# Altium schematic sheet SysUprTestUUDown.SchDoc
size 839 x 594 mm; DecimalNumber: Э- 917.02Э3; MainDevice: Плата источника питания; Name: Плата источника питания; PageSetup: Record=PageOptions|CenterHorizontal=True|CenterVertical=True|PrintScale=0.94|XCorrection=1.00|YCorrection=1.00|PrintKind=1|BorderSize=5000000|LeftOffset=0|BottomOffset=0|Orientation=1|PaperLength=1000|PaperWidth=1000|Scale=100|PaperSource=7|PrintQuality=-4|MediaType=1|DitherType=10|PaperKind=A4|PrintScaleMode=1; ApprovedBy: Кайбалдиев; CheckedBy: Савельев; DrawnBy: Соловьев; Engineer: Т.контр.; DocumentNumber: Э-917.02Э3; SheetNumber: 2; SheetTotal: 4; Title1str: Плата; Title2str: источника питания; DocumentType1str: Схема электрическая; DocumentType2str: принципиальная; ImagePath: Э-917.02
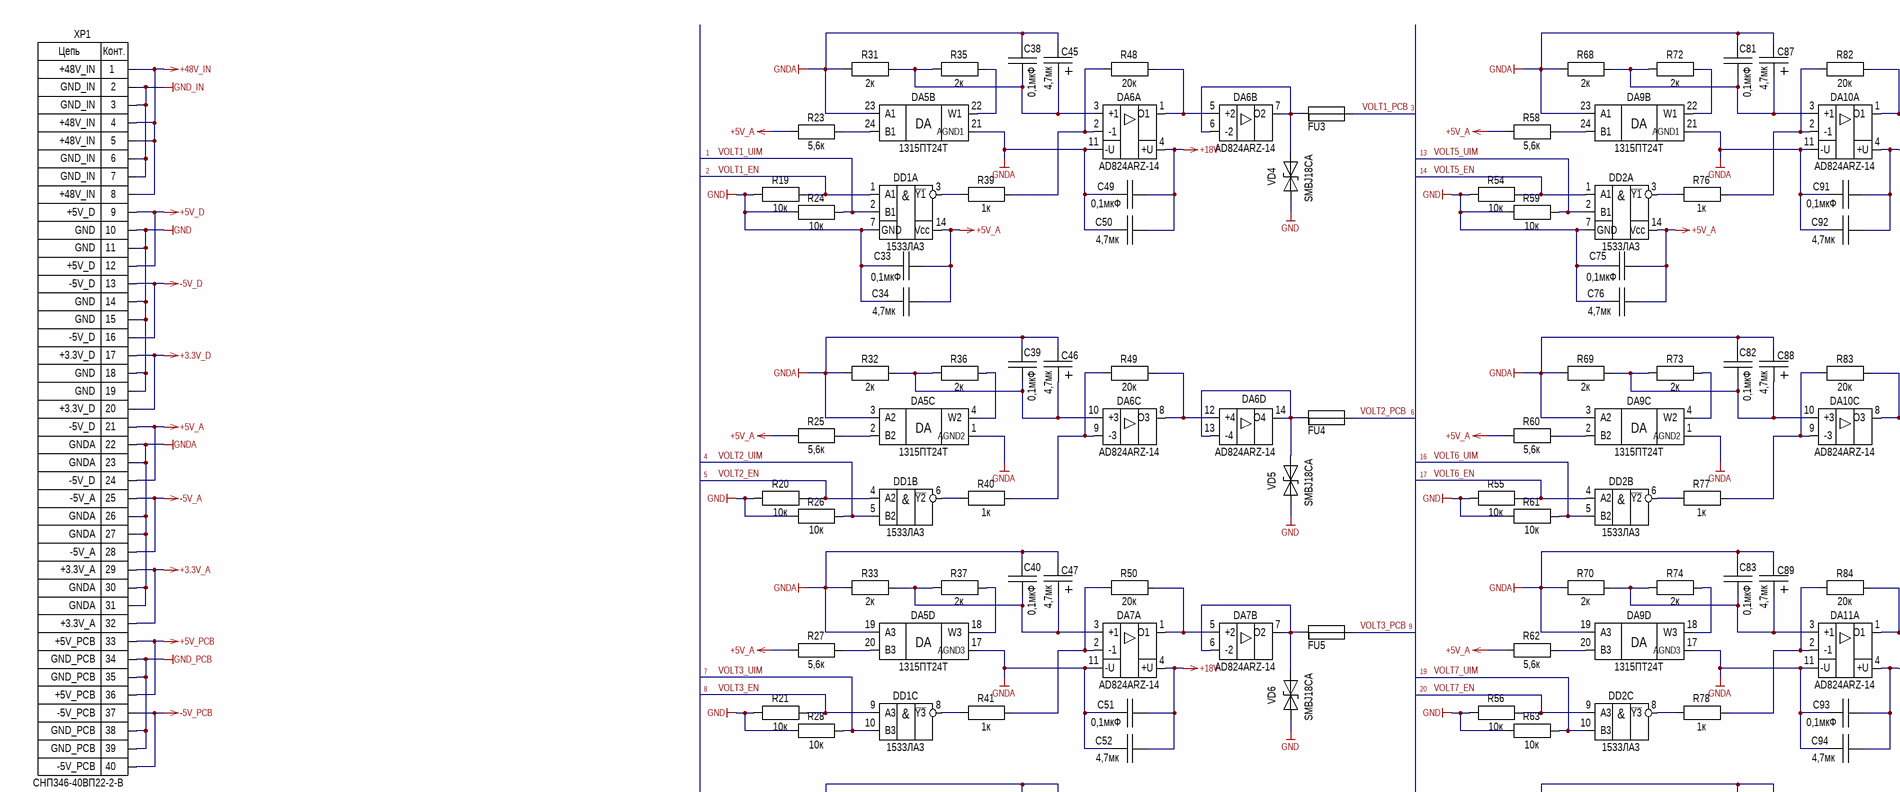
[diagram p0: SysUprTestUUDown.SchDoc, top left]
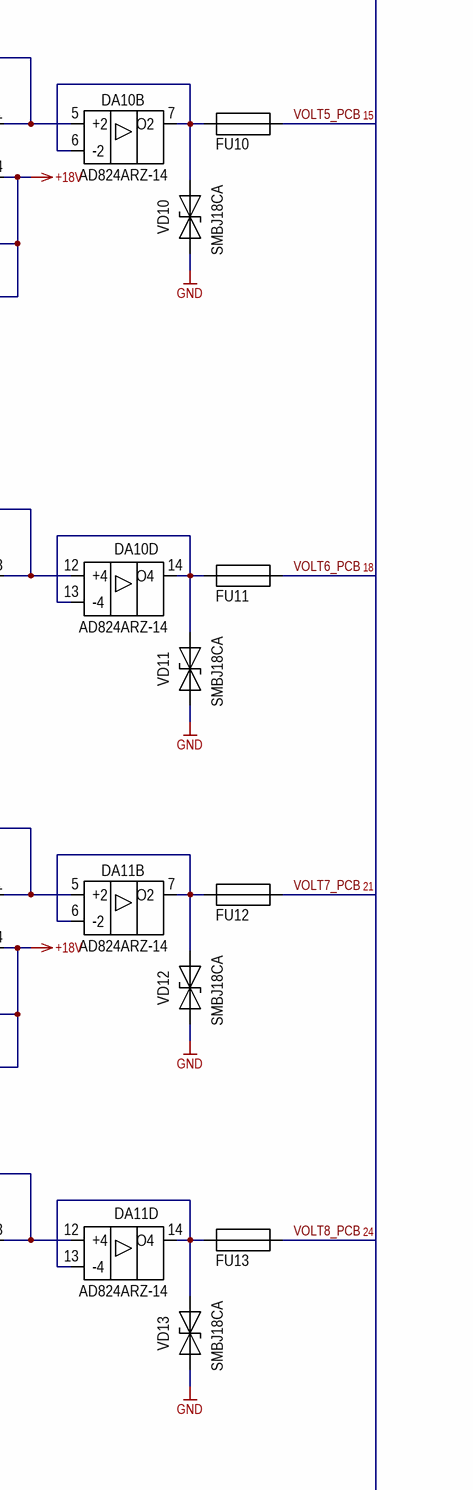
[diagram p1: SysUprTestUUDown.SchDoc, top right]
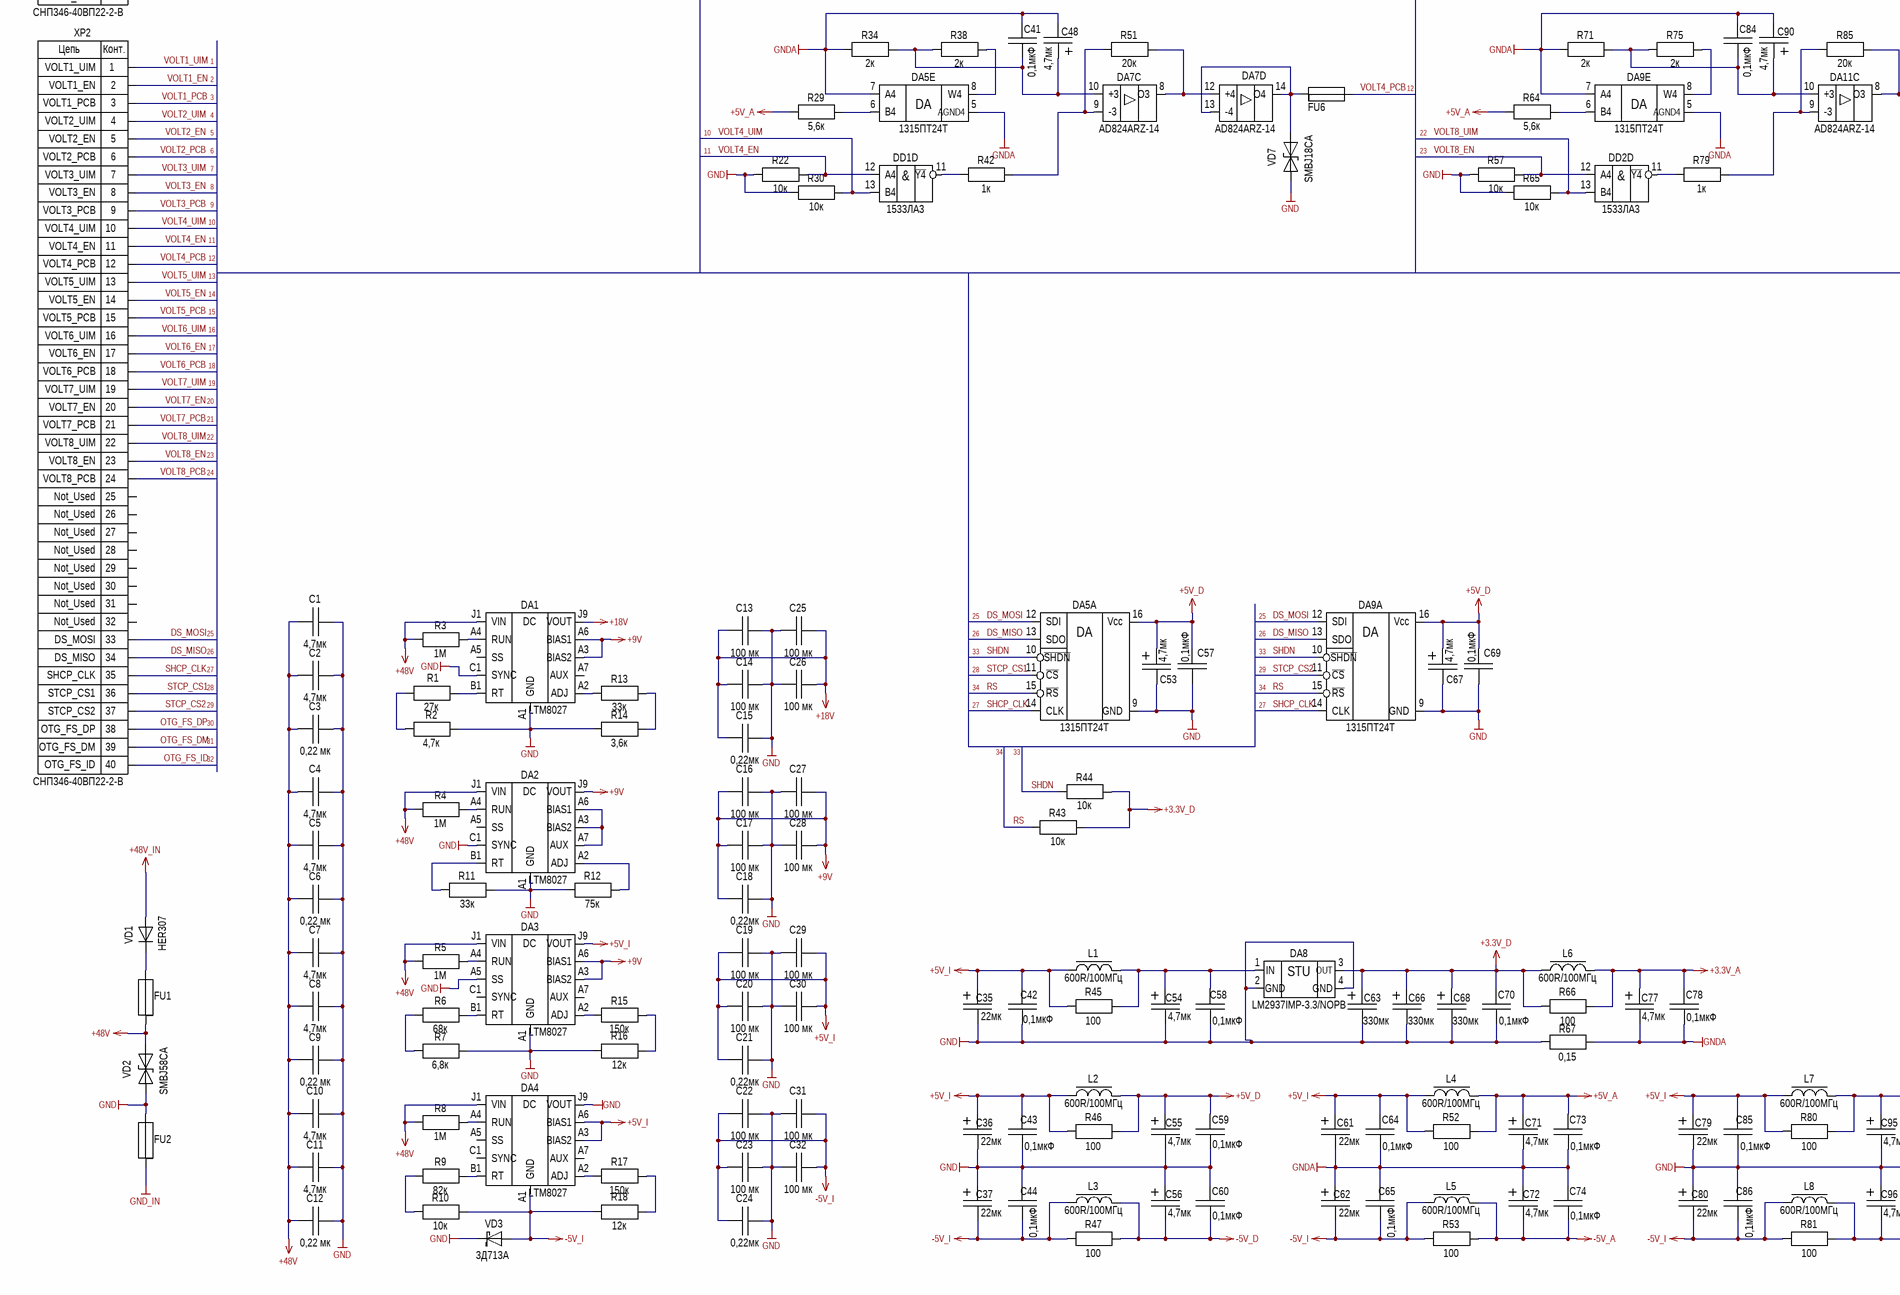
[diagram p2: SysUprTestUUDown.SchDoc, bottom left]
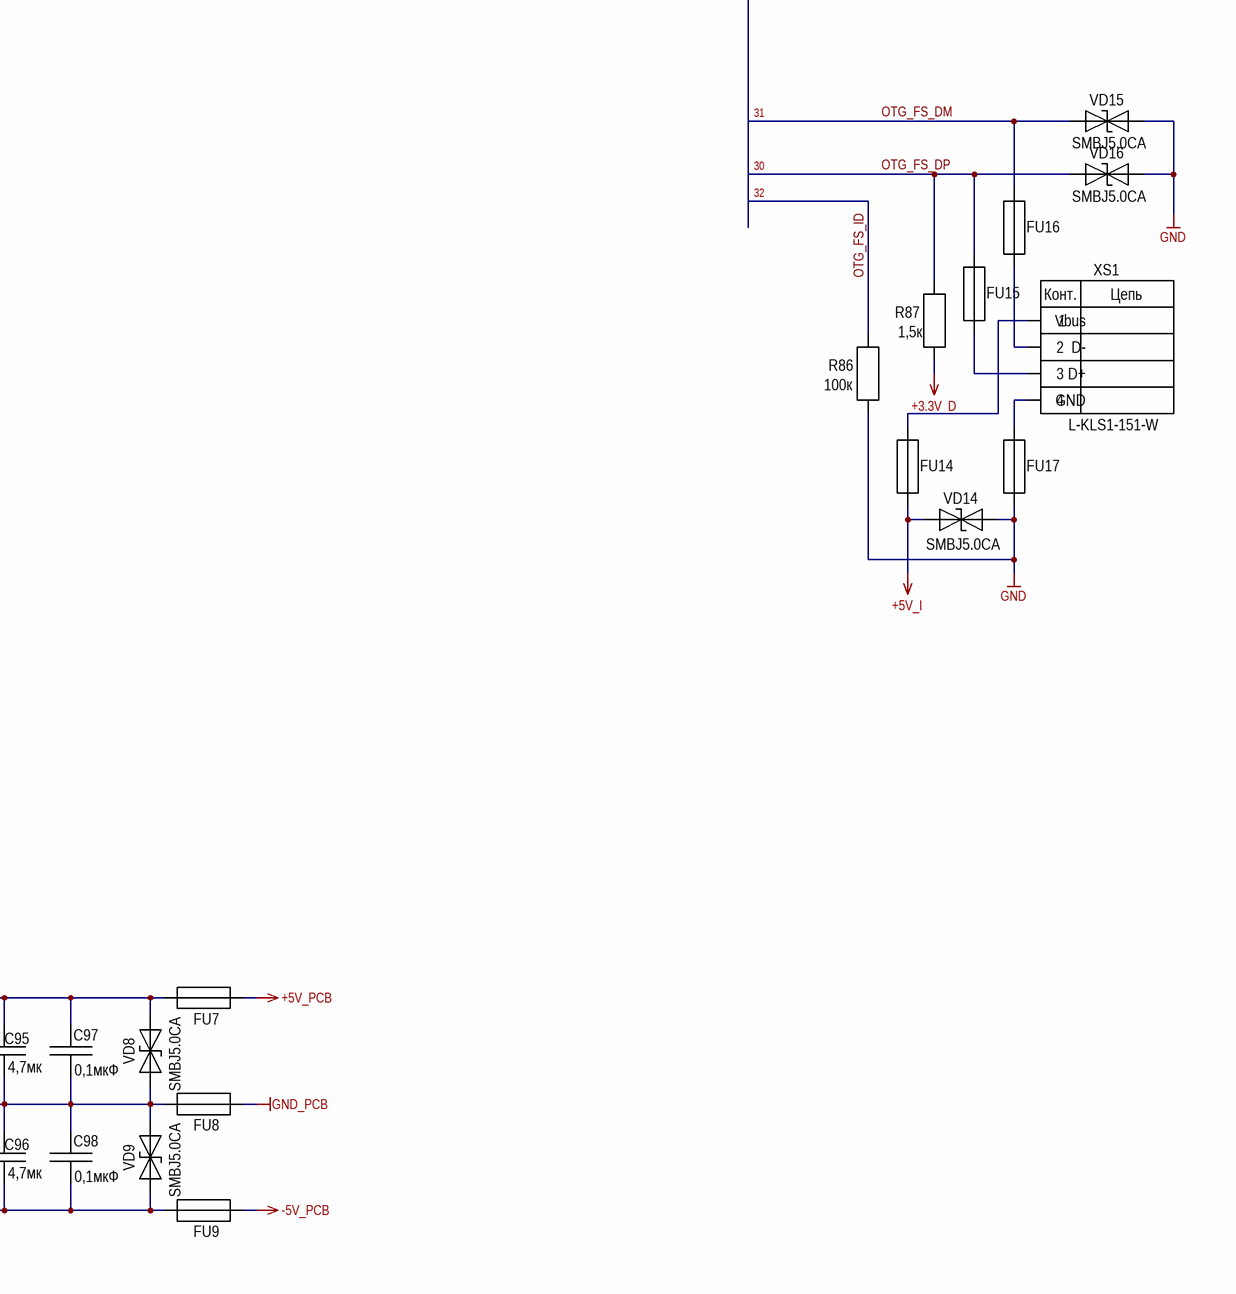
[diagram p3: SysUprTestUUDown.SchDoc, bottom right]

## Parts
C1  value 4,7мк  [CAP8060M H=5,6 мм]  (hidden comment: Capacitor)
C2  value 4,7мк  [CAP8060M H=5,6 мм]  (hidden comment: Capacitor)
C3  value 0,22 мк  [Cap1206]  (hidden comment: Capacitor)
C4  value 4,7мк  [CAP8060M H=5,6 мм]  (hidden comment: Capacitor)
C5  value 4,7мк  [CAP8060M H=5,6 мм]  (hidden comment: Capacitor)
C6  value 0,22 мк  [Cap1206]  (hidden comment: Capacitor)
C7  value 4,7мк  [CAP8060M H=5,6 мм]  (hidden comment: Capacitor)
C8  value 4,7мк  [CAP8060M H=5,6 мм]  (hidden comment: Capacitor)
C9  value 0,22 мк  [Cap1206]  (hidden comment: Capacitor)
C10  value 4,7мк  [CAP8060M H=5,6 мм]  (hidden comment: Capacitor)
C11  value 4,7мк  [CAP8060M H=5,6 мм]  (hidden comment: Capacitor)
C12  value 0,22 мк  [Cap1206]  (hidden comment: Capacitor)
C13  value 100 мк  [CAP2220 H=5.5мм]  (hidden comment: Capacitor)
C14  value 100 мк  [CAP2220 H=5.5мм]  (hidden comment: Capacitor)
C15  value 0,22мк  [Cap0805]  (hidden comment: Capacitor)
C16  value 100 мк  [CAP2220 H=5.5мм]  (hidden comment: Capacitor)
C17  value 100 мк  [CAP2220 H=5.5мм]  (hidden comment: Capacitor)
C18  value 0,22мк  [Cap0805]  (hidden comment: Capacitor)
C19  value 100 мк  [CAP2220 H=5.5мм]  (hidden comment: Capacitor)
C20  value 100 мк  [CAP2220 H=5.5мм]  (hidden comment: Capacitor)
C21  value 0,22мк  [Cap0805]  (hidden comment: Capacitor)
C22  value 100 мк  [CAP2220 H=5.5мм]  (hidden comment: Capacitor)
C23  value 100 мк  [CAP2220 H=5.5мм]  (hidden comment: Capacitor)
C24  value 0,22мк  [Cap0805]  (hidden comment: Capacitor)
C25  value 100 мк  [CAP2220 H=5.5мм]  (hidden comment: Capacitor)
C26  value 100 мк  [CAP2220 H=5.5мм]  (hidden comment: Capacitor)
C27  value 100 мк  [CAP2220 H=5.5мм]  (hidden comment: Capacitor)
C28  value 100 мк  [CAP2220 H=5.5мм]  (hidden comment: Capacitor)
C29  value 100 мк  [CAP2220 H=5.5мм]  (hidden comment: Capacitor)
C30  value 100 мк  [CAP2220 H=5.5мм]  (hidden comment: Capacitor)
C31  value 100 мк  [CAP2220 H=5.5мм]  (hidden comment: Capacitor)
C32  value 100 мк  [CAP2220 H=5.5мм]  (hidden comment: Capacitor)
C33  value 0,1мкФ  [Cap0805]  (hidden comment: Capacitor)
C34  value 4,7мк  [CAP1812]  (hidden comment: Capacitor)
C35  value 22мк  [CapCaseC]  (hidden comment: PolCap)
C36  value 22мк  [CapCaseC]  (hidden comment: PolCap)
C37  value 22мк  [CapCaseC]  (hidden comment: PolCap)
C38  value 0,1мкФ  [Cap0805]  (hidden comment: Capacitor)
C39  value 0,1мкФ  [Cap0805]  (hidden comment: Capacitor)
C40  value 0,1мкФ  [Cap0805]  (hidden comment: Capacitor)
C41  value 0,1мкФ  [Cap0805]  (hidden comment: Capacitor)
C42  value 0,1мкФ  [Cap0805]  (hidden comment: Capacitor)
C43  value 0,1мкФ  [Cap0805]  (hidden comment: Capacitor)
C44  value 0,1мкФ  [Cap0805]  (hidden comment: Capacitor)
C45  value 4,7мк  [CapCaseB]  (hidden comment: PolCap)
C46  value 4,7мк  [CapCaseB]  (hidden comment: PolCap)
C47  value 4,7мк  [CapCaseB]  (hidden comment: PolCap)
C48  value 4,7мк  [CapCaseB]  (hidden comment: PolCap)
C49  value 0,1мкФ  [Cap0805]  (hidden comment: Capacitor)
C50  value 4,7мк  [CAP1812]  (hidden comment: Capacitor)
C51  value 0,1мкФ  [Cap0805]  (hidden comment: Capacitor)
C52  value 4,7мк  [CAP1812]  (hidden comment: Capacitor)
C53  value 4,7мк  [CapCaseB]  (hidden comment: PolCap)
C54  value 4,7мк  [CapCaseB]  (hidden comment: PolCap)
C55  value 4,7мк  [CapCaseB]  (hidden comment: PolCap)
C56  value 4,7мк  [CapCaseB]  (hidden comment: PolCap)
C57  value 0,1мкФ  [Cap0805]  (hidden comment: Capacitor)
C58  value 0,1мкФ  [Cap0805]  (hidden comment: Capacitor)
C59  value 0,1мкФ  [Cap0805]  (hidden comment: Capacitor)
C60  value 0,1мкФ  [Cap0805]  (hidden comment: Capacitor)
C61  value 22мк  [CapCaseC]  (hidden comment: PolCap)
C62  value 22мк  [CapCaseC]  (hidden comment: PolCap)
C63  value 330мк  [CapCaseD]  (hidden comment: PolCap)
C64  value 0,1мкФ  [Cap0805]  (hidden comment: Capacitor)
C65  value 0,1мкФ  [Cap0805]  (hidden comment: Capacitor)
C66  value 330мк  [CapCaseD]  (hidden comment: PolCap)
C67  value 4,7мк  [CapCaseB]  (hidden comment: PolCap)
C68  value 330мк  [CapCaseD]  (hidden comment: PolCap)
C69  value 0,1мкФ  [Cap0805]  (hidden comment: Capacitor)
C70  value 0,1мкФ  [Cap0805]  (hidden comment: Capacitor)
C71  value 4,7мк  [CapCaseB]  (hidden comment: PolCap)
C72  value 4,7мк  [CapCaseB]  (hidden comment: PolCap)
C73  value 0,1мкФ  [Cap0805]  (hidden comment: Capacitor)
C74  value 0,1мкФ  [Cap0805]  (hidden comment: Capacitor)
C75  value 0,1мкФ  [Cap0805]  (hidden comment: Capacitor)
C76  value 4,7мк  [CAP1812]  (hidden comment: Capacitor)
C77  value 4,7мк  [CapCaseB]  (hidden comment: PolCap)
C78  value 0,1мкФ  [Cap0805]  (hidden comment: Capacitor)
C79  value 22мк  [CapCaseC]  (hidden comment: PolCap)
C80  value 22мк  [CapCaseC]  (hidden comment: PolCap)
C81  value 0,1мкФ  [Cap0805]  (hidden comment: Capacitor)
C82  value 0,1мкФ  [Cap0805]  (hidden comment: Capacitor)
C83  value 0,1мкФ  [Cap0805]  (hidden comment: Capacitor)
C84  value 0,1мкФ  [Cap0805]  (hidden comment: Capacitor)
C85  value 0,1мкФ  [Cap0805]  (hidden comment: Capacitor)
C86  value 0,1мкФ  [Cap0805]  (hidden comment: Capacitor)
C87  value 4,7мк  [CapCaseB]  (hidden comment: PolCap)
C88  value 4,7мк  [CapCaseB]  (hidden comment: PolCap)
C89  value 4,7мк  [CapCaseB]  (hidden comment: PolCap)
C90  value 4,7мк  [CapCaseB]  (hidden comment: PolCap)
C91  value 0,1мкФ  [Cap0805]  (hidden comment: Capacitor)
C92  value 4,7мк  [CAP1812]  (hidden comment: Capacitor)
C93  value 0,1мкФ  [Cap0805]  (hidden comment: Capacitor)
C94  value 4,7мк  [CAP1812]  (hidden comment: Capacitor)
C95  value 4,7мк  [CapCaseB]  (hidden comment: PolCap)
C96  value 4,7мк  [CapCaseB]  (hidden comment: PolCap)
C97  value 0,1мкФ  [Cap0805]  (hidden comment: Capacitor)
C98  value 0,1мкФ  [Cap0805]  (hidden comment: Capacitor)
DA1  LTM8027MPV#PBF  [LTM8027_LGA-121]  (value not drawn)
DA2  LTM8027MPV#PBF  [LTM8027_LGA-121]  (value not drawn)
DA3  LTM8027MPV#PBF  [LTM8027_LGA-121]  (value not drawn)
DA4  LTM8027MPV#PBF  [LTM8027_LGA-121]  (value not drawn)
DA5  1315PT24  [4118.24-2_SOIC24]  (value not drawn)  (parts A,B,C,D,E of 5)
DA6  AD824  [SOIC14]  (value not drawn)  (parts A,B,C,D of 4)
DA7  AD824  [SOIC14]  (value not drawn)  (parts A,B,C,D of 4)
DA8  LM2937IMP-3.3  [SOT223]  (value not drawn)
DA9  1315PT24  [4118.24-2_SOIC24]  (value not drawn)  (parts A,B,C,D,E of 5)
DA10  AD824  [SOIC14]  (value not drawn)  (parts A,B,C,D of 4)
DA11  AD824  [SOIC14]  (value not drawn)  (parts A,B,C,D of 4)
DD1  1533LA3  [401.14-5]  (value not drawn)  (parts A,B,C,D of 4)
DD2  1533LA3  [401.14-5]  (value not drawn)  (parts A,B,C,D of 4)
FU1  Predoxranitel  [MF-MSMF_1]  (value not drawn)
FU2  Predoxranitel  [MF-MSMF_1]  (value not drawn)
FU3  Predoxranitel  [MF-MSMF_1]  (value not drawn)
FU4  Predoxranitel  [MF-MSMF_1]  (value not drawn)
FU5  Predoxranitel  [MF-MSMF_1]  (value not drawn)
FU6  Predoxranitel  [MF-MSMF_1]  (value not drawn)
FU7  Predoxranitel  [MF-MSMF_1]  (value not drawn)
FU8  Predoxranitel  [MF-MSMF_1]  (value not drawn)
FU9  Predoxranitel  [MF-MSMF_1]  (value not drawn)
FU10  Predoxranitel  [MF-MSMF_1]  (value not drawn)
FU11  Predoxranitel  [MF-MSMF_1]  (value not drawn)
FU12  Predoxranitel  [MF-MSMF_1]  (value not drawn)
FU13  Predoxranitel  [MF-MSMF_1]  (value not drawn)
FU14  Predoxranitel  [MF-MSMF_1]  (value not drawn)
FU15  Predoxranitel  [MF-MSMF_1]  (value not drawn)
FU16  Predoxranitel  [MF-MSMF_1]  (value not drawn)
FU17  Predoxranitel  [MF-MSMF_1]  (value not drawn)
L1  value 600R/100MГц  [Ind1206]  (hidden comment: Ferrit)
L2  value 600R/100MГц  [Ind1206]  (hidden comment: Ferrit)
L3  value 600R/100MГц  [Ind1206]  (hidden comment: Ferrit)
L4  value 600R/100MГц  [Ind1206]  (hidden comment: Ferrit)
L5  value 600R/100MГц  [Ind1206]  (hidden comment: Ferrit)
L6  value 600R/100MГц  [Ind1206]  (hidden comment: Ferrit)
L7  value 600R/100MГц  [Ind1206]  (hidden comment: Ferrit)
L8  value 600R/100MГц  [Ind1206]  (hidden comment: Ferrit)
R1  value 27к  [Res0603]  (hidden comment: Resistor01)
R2  value 4,7к  [Res0805]  (hidden comment: Resistor0125)
R3  value 1М  [Res0805]  (hidden comment: Resistor0125)
R4  value 1М  [Res0805]  (hidden comment: Resistor0125)
R5  value 1М  [Res0805]  (hidden comment: Resistor0125)
R6  value 68к  [Res0805]  (hidden comment: Resistor0125)
R7  value 6,8к  [Res0805]  (hidden comment: Resistor0125)
R8  value 1М  [Res0805]  (hidden comment: Resistor0125)
R9  value 82к  [Res0805]  (hidden comment: Resistor0125)
R10  value 10к  [Res0805]  (hidden comment: Resistor0125)
R11  value 33к  [Res0805]  (hidden comment: Resistor0125)
R12  value 75к  [Res0805]  (hidden comment: Resistor0125)
R13  value 33к  [Res0805]  (hidden comment: Resistor0125)
R14  value 3,6к  [Res0805]  (hidden comment: Resistor0125)
R15  value 150к  [Res0805]  (hidden comment: Resistor0125)
R16  value 12к  [Res0805]  (hidden comment: Resistor0125)
R17  value 150к  [Res0805]  (hidden comment: Resistor0125)
R18  value 12к  [Res0805]  (hidden comment: Resistor0125)
R19  value 10к  [Res0402]  (hidden comment: Resistor0062)
R20  value 10к  [Res0402]  (hidden comment: Resistor0062)
R21  value 10к  [Res0402]  (hidden comment: Resistor0062)
R22  value 10к  [Res0402]  (hidden comment: Resistor0062)
R23  value 5,6к  [Res0805]  (hidden comment: Resistor0125)
R24  value 10к  [Res0402]  (hidden comment: Resistor0062)
R25  value 5,6к  [Res0805]  (hidden comment: Resistor0125)
R26  value 10к  [Res0402]  (hidden comment: Resistor0062)
R27  value 5,6к  [Res0805]  (hidden comment: Resistor0125)
R28  value 10к  [Res0402]  (hidden comment: Resistor0062)
R29  value 5,6к  [Res0805]  (hidden comment: Resistor0125)
R30  value 10к  [Res0402]  (hidden comment: Resistor0062)
R31  value 2к  [Res0805]  (hidden comment: Resistor0125)
R32  value 2к  [Res0805]  (hidden comment: Resistor0125)
R33  value 2к  [Res0805]  (hidden comment: Resistor0125)
R34  value 2к  [Res0805]  (hidden comment: Resistor0125)
R35  value 2к  [Res0805]  (hidden comment: Resistor0125)
R36  value 2к  [Res0805]  (hidden comment: Resistor0125)
R37  value 2к  [Res0805]  (hidden comment: Resistor0125)
R38  value 2к  [Res0805]  (hidden comment: Resistor0125)
R39  value 1к  [Res0402]  (hidden comment: Resistor0062)
R40  value 1к  [Res0402]  (hidden comment: Resistor0062)
R41  value 1к  [Res0402]  (hidden comment: Resistor0062)
R42  value 1к  [Res0402]  (hidden comment: Resistor0062)
R43  value 10к  [Res0402]  (hidden comment: Resistor0062)
R44  value 10к  [Res0402]  (hidden comment: Resistor0062)
R45  value 100  [Res1206]  (hidden comment: Resistor025)
R46  value 100  [Res1206]  (hidden comment: Resistor025)
R47  value 100  [Res1206]  (hidden comment: Resistor025)
R48  value 20к  [Res0805]  (hidden comment: Resistor0125)
R49  value 20к  [Res0805]  (hidden comment: Resistor0125)
R50  value 20к  [Res0805]  (hidden comment: Resistor0125)
R51  value 20к  [Res0805]  (hidden comment: Resistor0125)
R52  value 100  [Res1206]  (hidden comment: Resistor025)
R53  value 100  [Res1206]  (hidden comment: Resistor025)
R54  value 10к  [Res0402]  (hidden comment: Resistor0062)
R55  value 10к  [Res0402]  (hidden comment: Resistor0062)
R56  value 10к  [Res0402]  (hidden comment: Resistor0062)
R57  value 10к  [Res0402]  (hidden comment: Resistor0062)
R58  value 5,6к  [Res0805]  (hidden comment: Resistor0125)
R59  value 10к  [Res0402]  (hidden comment: Resistor0062)
R60  value 5,6к  [Res0805]  (hidden comment: Resistor0125)
R61  value 10к  [Res0402]  (hidden comment: Resistor0062)
R62  value 5,6к  [Res0805]  (hidden comment: Resistor0125)
R63  value 10к  [Res0402]  (hidden comment: Resistor0062)
R64  value 5,6к  [Res0805]  (hidden comment: Resistor0125)
R65  value 10к  [Res0402]  (hidden comment: Resistor0062)
R66  value 100  [Res1206]  (hidden comment: Resistor025)
R67  value 0,15  [Res2512]  (hidden comment: Resistor1)
R68  value 2к  [Res0805]  (hidden comment: Resistor0125)
R69  value 2к  [Res0805]  (hidden comment: Resistor0125)
R70  value 2к  [Res0805]  (hidden comment: Resistor0125)
R71  value 2к  [Res0805]  (hidden comment: Resistor0125)
R72  value 2к  [Res0805]  (hidden comment: Resistor0125)
R73  value 2к  [Res0805]  (hidden comment: Resistor0125)
R74  value 2к  [Res0805]  (hidden comment: Resistor0125)
R75  value 2к  [Res0805]  (hidden comment: Resistor0125)
R76  value 1к  [Res0402]  (hidden comment: Resistor0062)
R77  value 1к  [Res0402]  (hidden comment: Resistor0062)
R78  value 1к  [Res0402]  (hidden comment: Resistor0062)
R79  value 1к  [Res0402]  (hidden comment: Resistor0062)
R80  value 100  [Res1206]  (hidden comment: Resistor025)
R81  value 100  [Res1206]  (hidden comment: Resistor025)
R82  value 20к  [Res0805]  (hidden comment: Resistor0125)
R83  value 20к  [Res0805]  (hidden comment: Resistor0125)
R84  value 20к  [Res0805]  (hidden comment: Resistor0125)
R85  value 20к  [Res0805]  (hidden comment: Resistor0125)
R86  value 100к  [Res0805]  (hidden comment: Resistor0125)
R87  value 1,5к  [Res0805]  (hidden comment: Resistor0125)
VD1  Name: HER307  [DO-201AD]  (hidden comment: Diod)
VD2  Name: SMBJ58CA  [SMB_(DO-214AA) KA1-KA2]  (hidden comment: DiodZachitnuy)
VD3  Name: 3Д713А  [KD-4A 3D713A;3D713B]  (hidden comment: DiodShottky)
VD4  Name: SMBJ18CA  [SMB_(DO-214AA) KA1-KA2]  (hidden comment: DiodZachitnuy)
VD5  Name: SMBJ18CA  [SMB_(DO-214AA) KA1-KA2]  (hidden comment: DiodZachitnuy)
VD6  Name: SMBJ18CA  [SMB_(DO-214AA) KA1-KA2]  (hidden comment: DiodZachitnuy)
VD7  Name: SMBJ18CA  [SMB_(DO-214AA) KA1-KA2]  (hidden comment: DiodZachitnuy)
VD8  Name: SMBJ5.0CA  [SMB_(DO-214AA) KA1-KA2]  (hidden comment: DiodZachitnuy)
VD9  Name: SMBJ5.0CA  [SMB_(DO-214AA) KA1-KA2]  (hidden comment: DiodZachitnuy)
VD10  Name: SMBJ18CA  [SMB_(DO-214AA) KA1-KA2]  (hidden comment: DiodZachitnuy)
VD11  Name: SMBJ18CA  [SMB_(DO-214AA) KA1-KA2]  (hidden comment: DiodZachitnuy)
VD12  Name: SMBJ18CA  [SMB_(DO-214AA) KA1-KA2]  (hidden comment: DiodZachitnuy)
VD13  Name: SMBJ18CA  [SMB_(DO-214AA) KA1-KA2]  (hidden comment: DiodZachitnuy)
VD14  Name: SMBJ5.0CA  [SMB_(DO-214AA) KA1-KA2]  (hidden comment: DiodZachitnuy)
VD15  Name: SMBJ5.0CA  [SMB_(DO-214AA) KA1-KA2]  (hidden comment: DiodZachitnuy)
VD16  Name: SMBJ5.0CA  [SMB_(DO-214AA) KA1-KA2]  (hidden comment: DiodZachitnuy)
XP1  ConnectorP40  [PLD-40]  (value not drawn)
XP2  ConnectorP40  [PLD-40]  (value not drawn)